# EasyEDA Pro project Archive.eprj, schematic Schematic7_3
Board Name: 11643; Create Date: 2026-04-03; Page Name: P1; Project Name: Jarvis; Schematic Name: Schematic7_3; Update Date: 2026-04-03; Company: EasyEDA.com; Page Size: A4; Version: V1.0
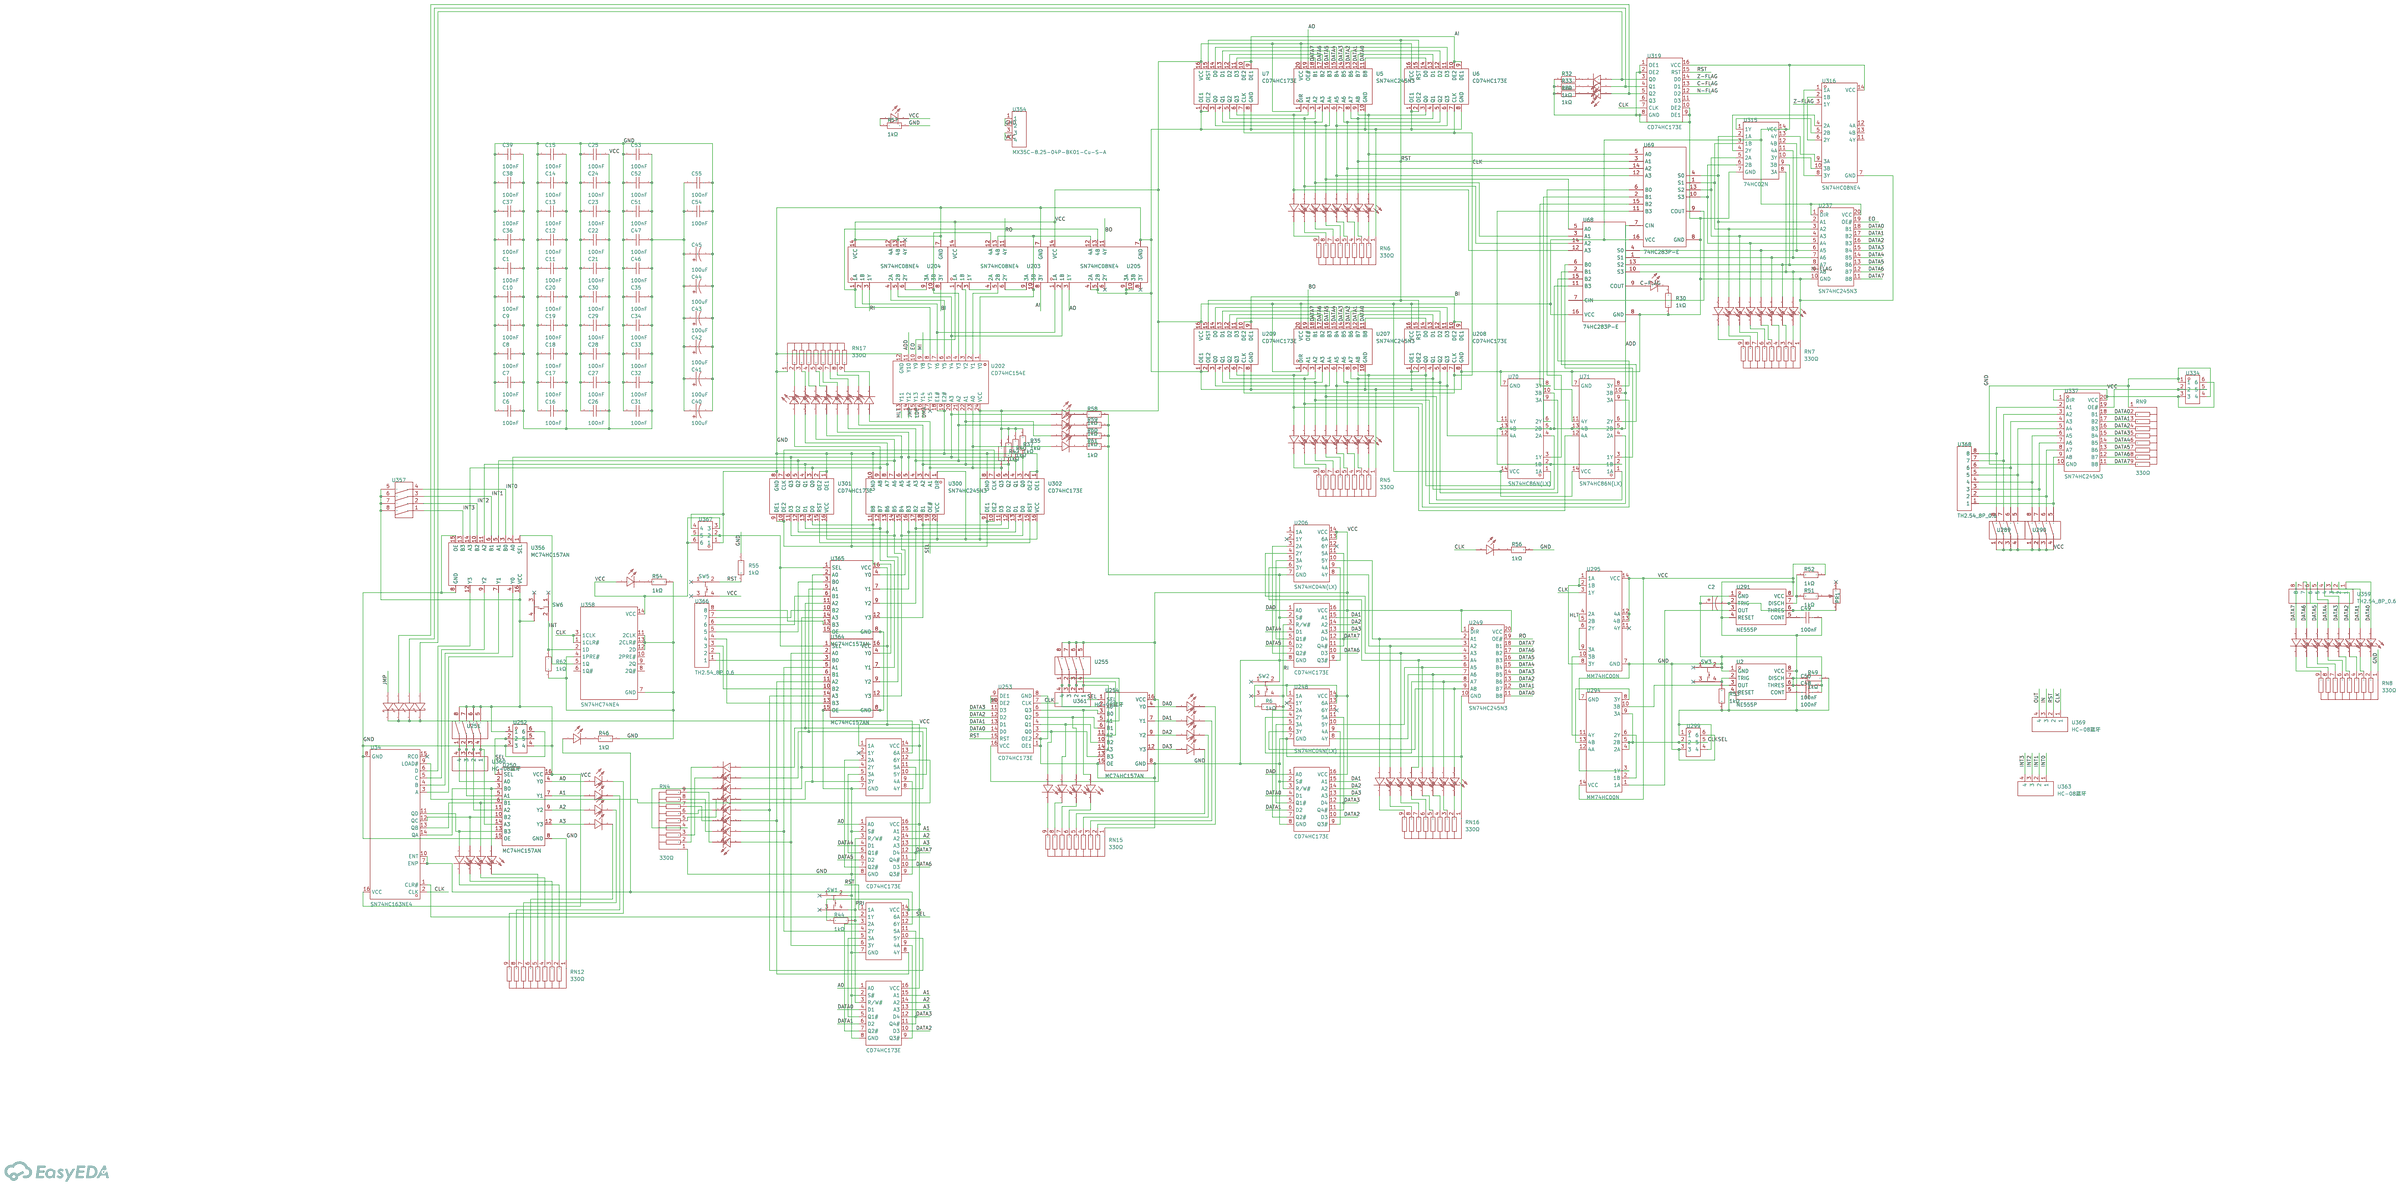
[diagram p0: schematic sheet]

## Parts
C1  100nF  [CAP-TH_L5.0-W2.5-P5.00-D1.0]
C2  100U/16V-6*11  [CAP-TH_BD6.4-P2.50-D0.5-FD]
C6  100nF  [CAP-TH_L5.0-W2.5-P5.00-D1.0]
C7  100nF  [CAP-TH_L5.0-W2.5-P5.00-D1.0]
C8  100nF  [CAP-TH_L5.0-W2.5-P5.00-D1.0]
C9  100nF  [CAP-TH_L5.0-W2.5-P5.00-D1.0]
C10  100nF  [CAP-TH_L5.0-W2.5-P5.00-D1.0]
C11  100nF  [CAP-TH_L5.0-W2.5-P5.00-D1.0]
C12  100nF  [CAP-TH_L5.0-W2.5-P5.00-D1.0]
C13  100nF  [CAP-TH_L5.0-W2.5-P5.00-D1.0]
C14  100nF  [CAP-TH_L5.0-W2.5-P5.00-D1.0]
C15  100nF  [CAP-TH_L5.0-W2.5-P5.00-D1.0]
C16  100nF  [CAP-TH_L5.0-W2.5-P5.00-D1.0]
C17  100nF  [CAP-TH_L5.0-W2.5-P5.00-D1.0]
C18  100nF  [CAP-TH_L5.0-W2.5-P5.00-D1.0]
C19  100nF  [CAP-TH_L5.0-W2.5-P5.00-D1.0]
C20  100nF  [CAP-TH_L5.0-W2.5-P5.00-D1.0]
C21  100nF  [CAP-TH_L5.0-W2.5-P5.00-D1.0]
C22  100nF  [CAP-TH_L5.0-W2.5-P5.00-D1.0]
C23  100nF  [CAP-TH_L5.0-W2.5-P5.00-D1.0]
C24  100nF  [CAP-TH_L5.0-W2.5-P5.00-D1.0]
C25  100nF  [CAP-TH_L5.0-W2.5-P5.00-D1.0]
C26  100nF  [CAP-TH_L5.0-W2.5-P5.00-D1.0]
C27  100nF  [CAP-TH_L5.0-W2.5-P5.00-D1.0]
C28  100nF  [CAP-TH_L5.0-W2.5-P5.00-D1.0]
C29  100nF  [CAP-TH_L5.0-W2.5-P5.00-D1.0]
C30  100nF  [CAP-TH_L5.0-W2.5-P5.00-D1.0]
C31  100nF  [CAP-TH_L5.0-W2.5-P5.00-D1.0]
C32  100nF  [CAP-TH_L5.0-W2.5-P5.00-D1.0]
C33  100nF  [CAP-TH_L5.0-W2.5-P5.00-D1.0]
C34  100nF  [CAP-TH_L5.0-W2.5-P5.00-D1.0]
C35  100nF  [CAP-TH_L5.0-W2.5-P5.00-D1.0]
C36  100nF  [CAP-TH_L5.0-W2.5-P5.00-D1.0]
C37  100nF  [CAP-TH_L5.0-W2.5-P5.00-D1.0]
C38  100nF  [CAP-TH_L5.0-W2.5-P5.00-D1.0]
C39  100nF  [CAP-TH_L5.0-W2.5-P5.00-D1.0]
C40  100uF  [CAP-TH_BD6.3-P2.50-D1.0-FD]
C41  100uF  [CAP-TH_BD6.3-P2.50-D1.0-FD]
C42  100uF  [CAP-TH_BD6.3-P2.50-D1.0-FD]
C43  100uF  [CAP-TH_BD6.3-P2.50-D1.0-FD]
C44  100uF  [CAP-TH_BD6.3-P2.50-D1.0-FD]
C45  100uF  [CAP-TH_BD6.3-P2.50-D1.0-FD]
C46  100nF  [CAP-TH_L5.0-W2.5-P5.00-D1.0]
C47  100nF  [CAP-TH_L5.0-W2.5-P5.00-D1.0]
C48  100nF  [CAP-TH_L5.0-W2.5-P5.00-D1.0]
C49  100nF  [CAP-TH_L5.0-W2.5-P5.00-D1.0]
C50  100nF  [CAP-TH_L5.0-W2.5-P5.00-D1.0]
C51  100nF  [CAP-TH_L5.0-W2.5-P5.00-D1.0]
C52  100nF  [CAP-TH_L5.0-W2.5-P5.00-D1.0]
C53  100nF  [CAP-TH_L5.0-W2.5-P5.00-D1.0]
C54  100nF  [CAP-TH_L5.0-W2.5-P5.00-D1.0]
C55  100nF  [CAP-TH_L5.0-W2.5-P5.00-D1.0]
PR1  -  [RES-ADJ-TH_3362P]
R6  1kΩ  [RES-TH_BD2.3-L6.5-P10.50-D0.5]
R30  1kΩ  [RES-TH_BD2.3-L6.5-P10.50-D0.5]
R32  1kΩ  [RES-TH_BD2.3-L6.5-P10.50-D0.5]
R33  1kΩ  [RES-TH_BD2.3-L6.5-P10.50-D0.5]
R34  1kΩ  [RES-TH_BD2.3-L6.5-P10.50-D0.5]
R35  1kΩ  [RES-TH_BD2.3-L6.5-P10.50-D0.5]
R37  1kΩ  [RES-TH_BD2.3-L6.5-P10.50-D0.5]
R40  1kΩ  [RES-TH_BD2.3-L6.5-P10.50-D0.5]
R42  1kΩ  [RES-TH_BD2.3-L6.5-P10.50-D0.5]
R44  1kΩ  [RES-TH_BD2.3-L6.5-P10.50-D0.5]
R46  1kΩ  [RES-TH_BD2.3-L6.5-P10.50-D0.5]
R49  1kΩ  [RES-TH_BD2.3-L6.5-P10.50-D0.5]
R51  1kΩ  [RES-TH_BD2.3-L6.5-P10.50-D0.5]
R52  1kΩ  [RES-TH_BD2.3-L6.5-P10.50-D0.5]
R53  1kΩ  [RES-TH_BD2.3-L6.5-P10.50-D0.5]
R54  1kΩ  [RES-TH_BD2.3-L6.5-P10.50-D0.5]
R55  1kΩ  [RES-TH_BD2.3-L6.5-P10.50-D0.5]
R56  1kΩ  [RES-TH_BD2.3-L6.5-P10.50-D0.5]
R57  1kΩ  [RES-TH_BD2.3-L6.5-P10.50-D0.5]
R58  1kΩ  [RES-TH_BD2.3-L6.5-P10.50-D0.5]
R59  1kΩ  [RES-TH_BD2.3-L6.5-P10.50-D0.5]
R60  1kΩ  [RES-TH_BD2.3-L6.5-P10.50-D0.5]
R61  1kΩ  [RES-TH_BD2.3-L6.5-P10.50-D0.5]
R62  1kΩ  [RES-TH_BD2.3-L6.5-P10.50-D0.5]
RN4  330Ω  [RES-ARRAY-TH_9P-P2.54-D1.0]
RN5  330Ω  [RES-ARRAY-TH_9P-P2.54-D1.0]
RN6  330Ω  [RES-ARRAY-TH_9P-P2.54-D1.0]
RN7  330Ω  [RES-ARRAY-TH_9P-P2.54-D1.0]
RN8  330Ω  [RES-ARRAY-TH_9P-P2.54-D1.0]
RN9  330Ω  [RES-ARRAY-TH_9P-P2.54-D1.0]
RN12  330Ω  [RES-ARRAY-TH_9P-P2.54-D1.0]
RN15  330Ω  [RES-ARRAY-TH_9P-P2.54-D1.0]
RN16  330Ω  [RES-ARRAY-TH_9P-P2.54-D1.0]
RN17  330Ω  [RES-ARRAY-TH_9P-P2.54-D1.0]
SW1  B3F-1000-S  [KEY-TH_4P-L6.2-W6.2-P4.50-LS6.5]
SW2  B3F-1000-S  [KEY-TH_4P-L6.2-W6.2-P4.50-LS6.5]
SW3  B3F-1000-S  [KEY-TH_4P-L6.2-W6.2-P4.50-LS6.5]
SW5  B3F-1000-S  [KEY-TH_4P-L6.2-W6.2-P4.50-LS6.5]
SW6  B3F-1000-S  [KEY-TH_4P-L6.2-W6.2-P4.50-LS6.5]
U1  CD74HC173E  [PDIP-16_L19.2-W6.6-P2.54-LS7.6-BL]
U2  NE555P  [DIP-8_L9.8-W6.6-P2.54-LS7.6-BL]
U5  SN74HC245N3  [PDIP-20_L25.9-W6.6-P2.54-LS7.9-BL]
U6  CD74HC173E  [PDIP-16_L19.2-W6.6-P2.54-LS7.6-BL]
U7  CD74HC173E  [PDIP-16_L19.2-W6.6-P2.54-LS7.6-BL]
U34  SN74HC163NE4  [PDIP-16_L19.3-W6.4-P2.54-LS7.94-BL]
U68  74HC283P-E  [PDIP-16_L19.3-W6.4-P2.54-LS7.94-BL]
U69  74HC283P-E  [PDIP-16_L19.3-W6.4-P2.54-LS7.94-BL]
U70  SN74HC86N(LX)  [PDIP-14_L19.3-W6.5-P2.54-LS7.6-BL]
U71  SN74HC86N(LX)  [PDIP-14_L19.3-W6.5-P2.54-LS7.6-BL]
U202  CD74HC154E  [DIP-24_L31.0-W13.5-P2.54-LS15.2-BL]
U203  SN74HC08NE4  [PDIP-14_L19.3-W6.5-P2.54-LS7.6-BL]
U204  SN74HC08NE4  [PDIP-14_L19.3-W6.5-P2.54-LS7.6-BL]
U205  SN74HC08NE4  [PDIP-14_L19.3-W6.5-P2.54-LS7.6-BL]
U206  SN74HC04N(LX)  [DIP-14_L19.6-W6.4-P2.54-LS7.6-BL]
U207  SN74HC245N3  [PDIP-20_L25.9-W6.6-P2.54-LS7.9-BL]
U208  CD74HC173E  [PDIP-16_L19.2-W6.6-P2.54-LS7.6-BL]
U209  CD74HC173E  [PDIP-16_L19.2-W6.6-P2.54-LS7.6-BL]
U210  SN74HC04N(LX)  [DIP-14_L19.6-W6.4-P2.54-LS7.6-BL]
U211  CD74HC173E  [PDIP-16_L19.2-W6.6-P2.54-LS7.6-BL]
U212  SN74HC04N(LX)  [DIP-14_L19.6-W6.4-P2.54-LS7.6-BL]
U213  LED  [LED-TH_BD4.0-P2.54-FD_RED]
U214  LED  [LED-TH_BD4.0-P2.54-FD_RED]
U215  LED  [LED-TH_BD4.0-P2.54-FD_RED]
U216  LED  [LED-TH_BD4.0-P2.54-FD_RED]
U217  LED  [LED-TH_BD4.0-P2.54-FD_RED]
U218  LED  [LED-TH_BD4.0-P2.54-FD_RED]
U219  LED  [LED-TH_BD4.0-P2.54-FD_RED]
U220  LED  [LED-TH_BD4.0-P2.54-FD_RED]
U221  LED  [LED-TH_BD4.0-P2.54-FD_RED]
U222  LED  [LED-TH_BD4.0-P2.54-FD_RED]
U223  LED  [LED-TH_BD4.0-P2.54-FD_RED]
U224  LED  [LED-TH_BD4.0-P2.54-FD_RED]
U225  LED  [LED-TH_BD4.0-P2.54-FD_RED]
U226  LED  [LED-TH_BD4.0-P2.54-FD_RED]
U227  LED  [LED-TH_BD4.0-P2.54-FD_RED]
U228  LED  [LED-TH_BD4.0-P2.54-FD_RED]
U229  LED  [LED-TH_BD4.0-P2.54-FD_RED]
U230  LED  [LED-TH_BD4.0-P2.54-FD_RED]
U231  LED  [LED-TH_BD4.0-P2.54-FD_RED]
U232  LED  [LED-TH_BD4.0-P2.54-FD_RED]
U233  LED  [LED-TH_BD4.0-P2.54-FD_RED]
U234  LED  [LED-TH_BD4.0-P2.54-FD_RED]
U235  LED  [LED-TH_BD4.0-P2.54-FD_RED]
U236  LED  [LED-TH_BD4.0-P2.54-FD_RED]
U237  SN74HC245N3  [PDIP-20_L25.9-W6.6-P2.54-LS7.9-BL]
U238  LED  [LED-TH_BD4.0-P2.54-FD_RED]
U239  LED  [LED-TH_BD4.0-P2.54-FD_RED]
U240  LED  [LED-TH_BD4.0-P2.54-FD_RED]
U241  LED  [LED-TH_BD4.0-P2.54-FD_RED]
U242  LED  [LED-TH_BD4.0-P2.54-FD_RED]
U243  LED  [LED-TH_BD4.0-P2.54-FD_RED]
U244  LED  [LED-TH_BD4.0-P2.54-FD_RED]
U245  LED  [LED-TH_BD4.0-P2.54-FD_RED]
U248  SN74HC04N(LX)  [DIP-14_L19.6-W6.4-P2.54-LS7.6-BL]
U249  SN74HC245N3  [PDIP-20_L25.9-W6.6-P2.54-LS7.9-BL]
U250  MC74HC157AN  [PDIP-16_L19.3-W6.4-P2.54-LS7.94-BL]
U251  switch4bitDIP  [DIP-8_L11.2-W6.2-P2.54-LS7.6-BL]
U252  KEY_8*8  [KEY-TH_6P-L7.1-W7.1-P2.00]
U253  CD74HC173E  [PDIP-16_L19.2-W6.6-P2.54-LS7.6-BL]
U254  MC74HC157AN  [PDIP-16_L19.3-W6.4-P2.54-LS7.94-BL]
U255  switch4bitDIP  [DIP-8_L11.2-W6.2-P2.54-LS7.6-BL]
U256  LED  [LED-TH_BD4.0-P2.54-FD_RED]
U257  LED  [LED-TH_BD4.0-P2.54-FD_RED]
U258  LED  [LED-TH_BD4.0-P2.54-FD_RED]
U259  LED  [LED-TH_BD4.0-P2.54-FD_RED]
U268  LED  [LED-TH_BD4.0-P2.54-FD_RED]
U269  LED  [LED-TH_BD4.0-P2.54-FD_RED]
U270  LED  [LED-TH_BD4.0-P2.54-FD_RED]
U271  LED  [LED-TH_BD4.0-P2.54-FD_RED]
U272  LED  [LED-TH_BD4.0-P2.54-FD_RED]
U273  LED  [LED-TH_BD4.0-P2.54-FD_RED]
U274  LED  [LED-TH_BD4.0-P2.54-FD_RED]
U275  LED  [LED-TH_BD4.0-P2.54-FD_RED]
U276  LED  [LED-TH_BD4.0-P2.54-FD_RED]
U277  LED  [LED-TH_BD4.0-P2.54-FD_RED]
U278  LED  [LED-TH_BD4.0-P2.54-FD_RED]
U279  LED  [LED-TH_BD4.0-P2.54-FD_RED]
U280  LED  [LED-TH_BD4.0-P2.54-FD_RED]
U281  LED  [LED-TH_BD4.0-P2.54-FD_RED]
U282  LED  [LED-TH_BD4.0-P2.54-FD_RED]
U283  LED  [LED-TH_BD4.0-P2.54-FD_RED]
U284  LED  [LED-TH_BD4.0-P2.54-FD_RED]
U285  LED  [LED-TH_BD4.0-P2.54-FD_RED]
U286  LED  [LED-TH_BD4.0-P2.54-FD_RED]
U287  LED  [LED-TH_BD4.0-P2.54-FD_RED]
U288  LED  [LED-TH_BD4.0-P2.54-FD_RED]
U289  switch4bitDIP  [DIP-8_L11.2-W6.2-P2.54-LS7.6-BL]
U290  switch4bitDIP  [DIP-8_L11.2-W6.2-P2.54-LS7.6-BL]
U291  NE555P  [DIP-8_L9.8-W6.6-P2.54-LS7.6-BL]
U294  MM74HC00N  [PDIP-14_L19.3-W6.4-P2.54-LS9.0-BL]
U295  MM74HC00N  [PDIP-14_L19.3-W6.4-P2.54-LS9.0-BL]
U296  CD74HC173E  [PDIP-16_L19.2-W6.6-P2.54-LS7.6-BL]
U297  CD74HC173E  [PDIP-16_L19.2-W6.6-P2.54-LS7.6-BL]
U298  LED  [LED-TH_BD4.0-P2.54-FD_RED]
U299  KEY_8*8  [KEY-TH_6P-L7.1-W7.1-P2.00]
U300  SN74HC245N3  [PDIP-20_L25.9-W6.6-P2.54-LS7.9-BL]
U301  CD74HC173E  [PDIP-16_L19.2-W6.6-P2.54-LS7.6-BL]
U302  CD74HC173E  [PDIP-16_L19.2-W6.6-P2.54-LS7.6-BL]
U307  LED  [LED-TH_BD4.0-P2.54-FD_RED]
U308  LED  [LED-TH_BD4.0-P2.54-FD_RED]
U309  LED  [LED-TH_BD4.0-P2.54-FD_RED]
U310  LED  [LED-TH_BD4.0-P2.54-FD_RED]
U311  LED  [LED-TH_BD4.0-P2.54-FD_RED]
U312  LED  [LED-TH_BD4.0-P2.54-FD_RED]
U313  LED  [LED-TH_BD4.0-P2.54-FD_RED]
U314  LED  [LED-TH_BD4.0-P2.54-FD_RED]
U315  74HC02N  [DIP-14_L19.6-W6.4-P2.54-LS7.6-BL]
U316  SN74HC08NE4  [PDIP-14_L19.3-W6.5-P2.54-LS7.6-BL]
U319  CD74HC173E  [PDIP-16_L19.2-W6.6-P2.54-LS7.6-BL]
U322  LED  [LED-TH_BD4.0-P2.54-FD_RED]
U328  LED  [LED-TH_BD4.0-P2.54-FD_RED]
U329  LED  [LED-TH_BD4.0-P2.54-FD_RED]
U330  LED  [LED-TH_BD4.0-P2.54-FD_RED]
U331  LED  [LED-TH_BD4.0-P2.54-FD_RED]
U332  LED  [LED-TH_BD4.0-P2.54-FD_RED]
U334  KEY_8*8  [KEY-TH_6P-L7.1-W7.1-P2.00]
U337  SN74HC245N3  [PDIP-20_L25.9-W6.6-P2.54-LS7.9-BL]
U338  LED  [LED-TH_BD4.0-P2.54-FD_RED]
U339  LED  [LED-TH_BD4.0-P2.54-FD_RED]
U340  LED  [LED-TH_BD4.0-P2.54-FD_RED]
U341  LED  [LED-TH_BD4.0-P2.54-FD_RED]
U342  LED  [LED-TH_BD4.0-P2.54-FD_RED]
U343  LED  [LED-TH_BD4.0-P2.54-FD_RED]
U344  LED  [LED-TH_BD4.0-P2.54-FD_RED]
U345  LED  [LED-TH_BD4.0-P2.54-FD_RED]
U346  LED  [LED-TH_BD4.0-P2.54-FD_RED]
U347  LED  [LED-TH_BD4.0-P2.54-FD_RED]
U348  LED  [LED-TH_BD4.0-P2.54-FD_RED]
U349  LED  [LED-TH_BD4.0-P2.54-FD_RED]
U350  1N4007-DIODE  [DO-41_BD2.4-L4.7-P8.70-D0.8-FD]
U351  1N4007-DIODE  [DO-41_BD2.4-L4.7-P8.70-D0.8-FD]
U352  1N4007-DIODE  [DO-41_BD2.4-L4.7-P8.70-D0.8-FD]
U353  1N4007-DIODE  [DO-41_BD2.4-L4.7-P8.70-D0.8-FD]
U354  MX35C-8.25-04P-BK01-Cu-S-A  [CONN-TH_4P-P8.25_MX35C-8.25-04P-BK01-CU-S-A]
U356  MC74HC157AN  [PDIP-16_L19.3-W6.4-P2.54-LS7.94-BL]
U357  switch4bitDIP  [DIP-8_L11.2-W6.2-P2.54-LS7.6-BL]
U358  SN74HC74NE4  [PDIP-14_L19.3-W6.4-P2.54-LS9.0-BL]
U359  TH2.54_8P_0.6  [HDR-TH_8P-P2.54-V-M-3]
U360  HC-08蓝牙  [HDR-TH_4P-P2.54-V-F]
U361  HC-08蓝牙  [HDR-TH_4P-P2.54-V-F]
U363  HC-08蓝牙  [HDR-TH_4P-P2.54-V-F]
U364  MC74HC157AN  [PDIP-16_L19.3-W6.4-P2.54-LS7.94-BL]
U365  MC74HC157AN  [PDIP-16_L19.3-W6.4-P2.54-LS7.94-BL]
U366  TH2.54_8P_0.6  [HDR-TH_8P-P2.54-V-M-3]
U367  KEY_8*8  [KEY-TH_6P-L7.1-W7.1-P2.00]
U368  TH2.54_8P_0.6  [HDR-TH_8P-P2.54-V-M-3]
U369  HC-08蓝牙  [HDR-TH_4P-P2.54-V-F]

## Library data of the parts
C1 C6-C39 C46-C55 = 178MU0006: Capacitance:100nF Tolerance:±10% Tolerance:±10% Voltage Rating:50V Temperature Coefficient:X7R Pin Spacing:2.54mm; LCSC Part Name: 100nF ±10% 50V; Supplier Part: C5632430; Manufacturer: KNSCHA(科尼盛); Supplier Footprint: 插件,P=2.54mm; JLCPCB Part Class: Extended Part; Datasheet: https://item.szlcsc.com/datasheet/178MU0006/6552585.html; Supplier: LCSC; Tolerance: ±10%; Voltage Rating: 50V; Temperature Coefficient: X7R; Pin Spacing: 2.54mm
C2 = 100U/16V-6*11: Supplier Part: C9900003239; Supplier Footprint: CAP-TH-BD6.4-P2.26-D0.5; JLCPCB Part Class: Extended Part; Supplier: LCSC
C40-C45 = NXA35VB100M6.3*11_LO: Capacitance: Rated Voltage: Lead Spacing: φD: L: Lifetime @ Temp:; LCSC Part Name: 100uF 35V; Supplier Part: C346956; Supplier Footprint: 插件,6.3x11mm; JLCPCB Part Class: Extended Part; Supplier: LCSC
PR1 = 环保 3362P-1-503LF: Resistance:- Rated Voltage:- Power(Watts):- Turns:-; LCSC Part Name: 50KΩ; Supplier Part: C5054; Supplier Footprint: VR-3362P; JLCPCB Part Class: Extended Part; Supplier: LCSC
R6 R30 R32-R35 R37 R40 R42 R44 R46 R49 R51-R62 = MF1/4W-1KΩ±1%T52: Type:Metal Film Resistors Resistance: Tolerance:±1% Tolerance:±1% Power(Watts):250mW Temperature Coefficient:±200ppm/℃ Temperature Coefficient:±200ppm/℃; LCSC Part Name: 金属膜电阻 1kΩ ±1% 250mW; Supplier Part: C713997; Manufacturer: 华星机电; Supplier Footprint: 插件,D2.3xL6.5mm; JLCPCB Part Class: Extended Part; Datasheet: https://atta.szlcsc.com/upload/public/pdf/source/20200731/C713882_AE8EB1102749D7E4FB4FB13DC898C429.pdf; Supplier: LCSC; Type: Metal Film Resistors; Tolerance: ±1%; Power(Watts): 250mW; Temperature Coefficient: ±200ppm/℃
RN4-RN9 RN12 RN15-RN17 = RAA09331G: Number of Resistors: Resistance: Tolerance:±2% Tolerance:±2% Power(Watts): Temperature Coefficient:±100ppm/℃ Temperature Coefficient:±100ppm/℃ Number of Pins:; LCSC Part Name: 330Ω ±2%; Supplier Part: C353617; Manufacturer: Monec(鑫汇); Supplier Footprint: SIP-9-2.54mm; JLCPCB Part Class: Extended Part; Datasheet: https://atta.szlcsc.com/upload/public/pdf/source/20190415/C353617_CE0FBC2F670EA1E78594FBF4B85EE317.pdf; Supplier: LCSC; Tolerance: ±2%; Temperature Coefficient: ±100ppm/℃
SW1-SW3 SW5 SW6 = B3F-1000-S: Supplier Part: C19724130; Manufacturer: OMRON(欧姆龙); Supplier Footprint: SW-TH_4P; JLCPCB Part Class: Extended Part; Datasheet: https://item.szlcsc.com/datasheet/B3F-1000-S/21045793.html; Supplier: LCSC
U1 U6 U7 U208 U209 U211 U253 U296 U297 U301 U302 U319 = CD74HC173E: Type:D-Type Trigger Type:Rising Edge Voltage - Supply:2V~6V Voltage - Supply:2V~6V Clock Frequency:60MHz Function:Reset Number of Elements:1 Number of Bits per Element:4 Output Type:Tri-State Propagation Delay:34ns@6V,50pF Series:74HC Series Current - Out; LCSC Part Name: 三态高速CMOS逻辑四路D型触发器; Supplier Part: C1549968; Manufacturer: TI(德州仪器); Supplier Footprint: PDIP-16; JLCPCB Part Class: Extended Part; Datasheet: https://www.ti.com/cn/lit/gpn/cd74hct173; Supplier: LCSC; Type: D-Type; Trigger Type: Rising Edge; Voltage - Supply: 2V~6V; Clock Frequency: 60MHz; Function: Reset; Number of Elements: 1; Number of Bits per Element: 4; Output Type: Tri-State; Propagation Delay: 34ns@6V,50pF; Series: 74HC Series; Current - Output Low(IOL): 7.8mA; Current - Output High(IOH): 7.8mA; Quiescent Current: 8uA; Input Capacitance: 10pF; Operating Temperature: -55℃~+125℃; Setup Time: 12ns; Hold Time: 3ns
U2 U291 = NE555P: Supplier Part: C46749; Manufacturer: TI(德州仪器); Supplier Footprint: DIP-8; JLCPCB Part Class: Extended Part; Datasheet: https://www.ti.com/cn/lit/gpn/ne555; Supplier: LCSC
U5 U207 U237 U249 U300 U337 = SN74HC245N3: Input type:- output type:Tri-State Voltage - Supply:2V~6V Voltage - Supply:2V~6V Number of Elements:1 Number of Bits per Element:8 Channel Type:Bidirectional Current - Output Low(IOL):7.8mA Current - Output High(IOH):7.8mA Logic Family:74HC Operating Temp; Supplier Part: C3587488; Manufacturer: TI(德州仪器); Supplier Footprint: PDIP-20; JLCPCB Part Class: Extended Part; Datasheet: https://item.szlcsc.com/datasheet/SN74HC245N3/4154202.html; Supplier: LCSC; output type: Tri-State; Voltage - Supply: 2V~6V; Number of Elements: 1; Number of Bits per Element: 8; Channel Type: Bidirectional; Current - Output Low(IOL): 7.8mA; Current - Output High(IOH): 7.8mA; Logic Family: 74HC; Operating Temperature: -40℃~+85℃; Quiescent Current: 80uA; Propagation Delay: 21ns@4.5V,50pF
U34 = SN74HC163NE4: Supplier Part: C20345717; Manufacturer: TI(德州仪器); Supplier Footprint: PDIP-16; JLCPCB Part Class: Extended Part; Datasheet: https://atta.szlcsc.com/upload/public/pdf/source/20240116/FC6F7C80FC5EB51F2BFA3EE0E58B1708.pdf; Supplier: LCSC
U68 U69 = 74HC283P-E: Supplier Part: C17688236; Manufacturer: RENESAS(瑞萨)/IDT; Datasheet: https://item.szlcsc.com/datasheet/74HC283P-E/18817510.html; Supplier: LCSC
U70 U71 = SN74HC86N(LX): Logic Type:XOR Gate Number of Channels:4 Voltage - Supply:2V~6V Voltage - Supply:2V~6V Quiescent Current:2uA Input Logic Level - High:1.5V~4.2V Input Logic Level - High:1.5V~4.2V Input Logic Level - Low:500mV~1.8V Input Logic Level - Low:500mV~1.8V Series; LCSC Part Name: 集成电路; Supplier Part: C22436661; Manufacturer: LX(灵星芯微); Supplier Footprint: DIP-14; JLCPCB Part Class: Extended Part; Datasheet: https://atta.szlcsc.com/upload/public/pdf/source/20240524/675B1C928075FFB7AC00BEC82378813F.pdf; Supplier: LCSC; Logic Type: XOR Gate; Number of Channels: 4; Voltage - Supply: 2V~6V; Quiescent Current: 2uA; Input Logic Level - High: 1.5V~4.2V; Input Logic Level - Low: 500mV~1.8V; Series: 74HCSeries; Operating Temperature: -40℃~+125℃
U202 = CD74HC154E: Supplier Part: C5342; Supplier Footprint: DIP-24-600mil; JLCPCB Part Class: Extended Part; Supplier: LCSC
U203-U205 U316 = SN74HC08NE4: Logic Type:AND Gate Number of Channels:4 Voltage - Supply:2V~6V Voltage - Supply:2V~6V Quiescent Current:20uA Current - Output Low(IOL):5.2mA Current - Output High(IOH):5.2mA Input Logic Level - High:1.5V；4.2V；3.15V Input Logic Level - High:1.5V；4.2V；3.15; Supplier Part: C20345708; Manufacturer: TI(德州仪器); Supplier Footprint: PDIP-14; JLCPCB Part Class: Extended Part; Datasheet: https://item.szlcsc.com/datasheet/SN74HC08NE4/21671235.html; Supplier: LCSC; Logic Type: AND Gate; Number of Channels: 4; Voltage - Supply: 2V~6V; Quiescent Current: 20uA; Current - Output Low(IOL): 5.2mA; Current - Output High(IOH): 5.2mA; Input Logic Level - High: 1.5V；4.2V；3.15V; Input Logic Level - Low: 1.35V；500mV；1.8V; Output Logic Level - High: 4.4V；5.9V；1.9V; Output Logic Level - Low: 330mV；260mV；100mV; Series: 74HC; Propagation Delay: 25ns@4.5V,50pF; Operating Temperature: -40℃~+85℃; Input Number: 2
U206 U210 U212 U248 = SN74HC04N(LX): Input Type:- Voltage - Supply:2V~6V Voltage - Supply:2V~6V Quiescent Current(Iq):2uA Number of Circuits:6 Number of Inputs:- Current - Output Low(IOL):- Current - Output High(IOH):- Input Logic Level - High:1.5V~4.2V Input Logic Level - High:1.5V~4.2V Inp; LCSC Part Name: 集成电路; Supplier Part: C22436641; Manufacturer: LX(灵星芯微); Supplier Footprint: DIP-14; JLCPCB Part Class: Extended Part; Datasheet: https://item.szlcsc.com/datasheet/SN74HC04N(LX)/24070577.html; Supplier: LCSC; Voltage - Supply: 2V~6V; Quiescent Current(Iq): 2uA; Number of Circuits: 6; Input Logic Level - High: 1.5V~4.2V; Input Logic Level -Low: 500mV~1.8V; Output Logic Level - High: 4.4V；5.9V；1.9V; Output Logic Level - Low: 260mV；260mV；100mV; Propagation Delay: 14ns@6V,50pF; Series: 74HC Series; Operating Temperature: -40℃~+125℃
U213-U236 U238-U245 U256-U259 U268-U288 U298 U307-U314 U322 U328-U332 U338-U349 = LED: Supplier Part: C9900015665; Supplier Footprint: SIP-2P; JLCPCB Part Class: Extended Part; Supplier: LCSC
U250 U254 U356 U364 U365 = MC74HC157AN: Type:Data Selector/Multiplexers Voltage Supply Source:Single supply Supply Voltage:2V~6V Supply Voltage:2V~6V Sink Current:7.8mA Source Current:7.8mA Operating temperature:-55℃~+125℃ Operating temperature:-55℃~+125℃; Supplier Part: C3231585; Manufacturer: onsemi(安森美); Supplier Footprint: PDIP-16; Datasheet: https://atta.szlcsc.com/upload/public/pdf/source/20230915/AA5F4BE3BD1C30F26D22E0E41BE72F14.pdf; Supplier: LCSC; Type: Data Selector/Multiplexers; Voltage Supply Source: Single supply; Supply Voltage: 2V~6V; Sink Current: 7.8mA; Source Current: 7.8mA; Operating temperature: -55℃~+125℃
U251 U255 U289 U290 U357 = switch4bitDIP: Supplier Part: C9900002361; Supplier Footprint: DIP-8_L11.16-W6.2-P2.54-LS7.62; Supplier: LCSC
U252 U299 U334 U367 = KEY_8*8: Supplier Part: C9900001793; Supplier Footprint: SW-TH_6P-L7.1-W7.1-P2.00-LS4.9; JLCPCB Part Class: Extended Part; Supplier: LCSC
U294 U295 = MM74HC00N: Logic Type:NAND Gate Number of Channels:4 Voltage - Supply:2V~6V Voltage - Supply:2V~6V Quiescent Current:2uA Current - Output Low(IOL):5.2mA Current - Output High(IOH):5.2mA Input Logic Level - High:1.5V~4.2V Input Logic Level - High:1.5V~4.2V Input Logi; Supplier Part: C4472810; Manufacturer: TI(德州仪器); Supplier Footprint: DIP-14; JLCPCB Part Class: Extended Part; Datasheet: https://atta.szlcsc.com/upload/public/pdf/source/20230920/AE4EE648A4D81869CF07AF2DDCC9D708.pdf; Supplier: LCSC; Logic Type: NAND Gate; Number of Channels: 4; Voltage - Supply: 2V~6V; Quiescent Current: 2uA; Current - Output Low(IOL): 5.2mA; Current - Output High(IOH): 5.2mA; Input Logic Level - High: 1.5V~4.2V; Series: 74HC Series; Propagation Delay: 15ns@6V,50pF; Operating Temperature: -40℃~+85℃
U315 = 74HC02N: Logic Type:NOR Gate Number of Channels:4 Voltage - Supply:2V~6V Voltage - Supply:2V~6V Quiescent Current:40uA Current - Output Low(IOL):25mA Current - Output High(IOH):25mA Input Logic Level - High:2.1V~4.2V Input Logic Level - High:2.1V~4.2V Input Logic; LCSC Part Name: 四路 2 输入 或非门; Supplier Part: C507193; Manufacturer: HGSEMI(华冠); Supplier Footprint: DIP-14; JLCPCB Part Class: Extended Part; Datasheet: https://item.szlcsc.com/datasheet/74HC02N/520631.html; Supplier: LCSC; Logic Type: NOR Gate; Number of Channels: 4; Voltage - Supply: 2V~6V; Quiescent Current: 40uA; Current - Output Low(IOL): 25mA; Current - Output High(IOH): 25mA; Input Logic Level - High: 2.1V~4.2V; Input Logic Level - Low: 900mV~1.8V; Output Logic Level - High: 4.4V~5.9V; Output Logic Level - Low: 100mV; Series: 74HC Series; Propagation Delay: 13ns@4.5V,50pF; Operating Temperature: -40℃~+85℃; Input Number: 2
U350-U353 = 1N4007-DIODE: Supplier Part: C9900005663; Supplier Footprint: DO-41; JLCPCB Part Class: Extended Part; Supplier: LCSC
U354 = MX35C-8.25-04P-BK01-Cu-S-A: Barrier Type:2-Side Pitch:8.25mm Number of Positions or Pins:1x4P Mounting Type:Straight Pin Location:Mid Terminal Number of Pins:4P Number of Rows:1 Number of PINs Per Row:4 Screw Specification:M3 Current Rating:20A Voltage Rating (Max):300V Wire Gauge -; LCSC Part Name: 8.25mm 1x4P 直插 中脚 排数:1 每排P数:4; Supplier Part: C5290387; Manufacturer: MAX(迈旭); Supplier Footprint: 插件,P=8.25mm; JLCPCB Part Class: Extended Part; Datasheet: https://item.szlcsc.com/datasheet/MX35C-8.25-04P-BK01-Cu-S-A/6031590.html; Supplier: LCSC; Barrier Type: 2-Side; Pitch: 8.25mm; Number of Positions or Pins: 1x4P; Mounting Type: Straight; Pin Location: Mid Terminal; Number of Pins: 4P; Number of Rows: 1; Number of PINs Per Row: 4; Screw Specification: M3; Current Rating: 20A; Voltage Rating (Max): 300V; Wire Gauge - AWG: 12~22; Wire Gauge - mm2: 2.5; Operating Temperature: -40℃~+105℃; Color: Black
U358 = SN74HC74NE4: Type:D-Type Trigger Type:Rising Edge Voltage - Supply:2V~6V Voltage - Supply:2V~6V Clock Frequency:31MHz Function:Set and Reset Number of Elements:2 Number of Bits per Element:1 Output Type:Push-Pull Propagation Delay:35ns Series:74HC Series Current - Out; LCSC Part Name: 双D型正边沿触发触发器，带清零和预置功能; Supplier Part: C20345733; Manufacturer: TI(德州仪器); Supplier Footprint: PDIP-14; JLCPCB Part Class: Extended Part; Datasheet: https://item.szlcsc.com/datasheet/SN74HC74NE4/21671260.html; Supplier: LCSC; Type: D-Type; Trigger Type: Rising Edge; Voltage - Supply: 2V~6V; Clock Frequency: 31MHz; Function: Set and Reset; Number of Elements: 2; Number of Bits per Element: 1; Output Type: Push-Pull; Propagation Delay: 35ns; Series: 74HC Series; Current - Output Low(IOL): 4mA; Current - Output High(IOH): 4mA; Quiescent Current: 4uA; Input Capacitance: 3pF; Operating Temperature: -40℃~+85℃; Synchronous/Asynchronous: Asynchronous; Setup Time: 20ns; Hold Time: 0ns
U359 U366 U368 = TH2.54_8P_0.6: Supplier Part: C9900018349; Supplier Footprint: HDR-TH-8P; JLCPCB Part Class: Extended Part; Supplier: LCSC
U360 U361 U363 U369 = HC-08蓝牙: Supplier Part: C9900016778; Supplier Footprint: HDR-TH_4P; JLCPCB Part Class: Extended Part; Supplier: LCSC

## Nets
GND: C1.2 C2.1 C6.2 C7.2 C8.2 C9.2 C10.2 C11.2 C12.2 C13.2 C14.2 C15.2 C16.2 C17.2 C18.2 C19.2 C20.2 C21.2 C22.2 C23.2 C24.2 C25.2 C26.2 C27.2 C28.2 C29.2 C30.2 C31.2 C32.2 C33.2 C34.2 C35.2 C36.2 C37.2 C38.2 C39.2 C40.2 C41.2 C42.2 C43.2 C44.2 C45.2 C46.2 C47.2 C48.1 C50.1 C51.2 C52.2 C53.2 C54.1 C55.1 R30.1 R32.2 R33.2 R34.2 R46.1 R54.1 R55.1 R56.2 R57.2 R58.2 R59.2 R60.2 R61.2 R62.2 RN4.1 RN5.1 RN6.1 RN7.1 RN8.1 RN9.1 RN12.1 RN15.1 RN16.1 RN17.1 SW1.2 SW2.2 SW3.2 U1.2(S#) U1.8(GND) U2.1(GND) U5.10(GND) U6.1(OE1) U6.2(OE2) U6.8(GND) U7.1(OE1) U7.2(OE2) U7.8(GND) U34.8(GND) U68.8(GND) U69.8(GND) U70.7(GND) U71.7(GND) U202.12(GND) U202.18(E1#) U202.19(E2#) U203.7(GND) U204.7(GND) U204.12(4A) U204.13(4B) U205.4(2A) U205.5(2B) U205.7(GND) U205.9(3A) U205.10(3B) U206.7(GND) U207.10(GND) U208.1(OE1) U208.2(OE2) U208.8(GND) U209.1(OE1) U209.2(OE2) U209.8(GND) U210.7(GND) U211.2(S#) U211.8(GND) U212.7(GND) U237.10(GND) U248.7(GND) U249.10(GND) U250.8(GND) U250.15(OE) U252.3 U252.6 U253.1(OE1) U253.2(OE2) U253.8(GND) U254.8(GND) U254.15(OE) U291.1(GND) U294.7(GND) U295.7(GND) U296.2(S#) U296.8(GND) U297.2(S#) U297.8(GND) U299.3 U299.6 U300.10(GND) U301.1(OE1) U301.2(OE2) U301.8(GND) U301.9(DE1) U301.10(DE2) U302.1(OE1) U302.2(OE2) U302.8(GND) U302.9(DE1) U302.10(DE2) U315.7(GND) U316.7(GND) U319.1(OE1) U319.2(OE2) U319.8(GND) U319.9(DE1) U319.10(DE2) U334.1 U334.4 U337.10(GND) U354.1 U354.2 U356.8(GND) U356.15(OE) U358.4(1PRE#) U358.7(GND) U358.11(2CLK) U358.12(2D) U358.13(2CLR#) U364.8(GND) U364.15(OE) U365.8(GND) U365.15(OE) U367.1 U367.4
VCC: C1.1 C6.1 C7.1 C8.1 C9.1 C10.1 C11.1 C12.1 C13.1 C14.1 C15.1 C16.1 C17.1 C18.1 C19.1 C20.1 C21.1 C22.1 C23.1 C24.1 C25.1 C26.1 C27.1 C28.1 C29.1 C30.1 C31.1 C32.1 C33.1 C34.1 C35.1 C36.1 C37.1 C38.1 C39.1 C40.1 C41.1 C42.1 C43.1 C44.1 C45.1 C46.1 C47.1 C49.1 C51.1 C52.1 C53.1 C54.2 C55.2 R6.1 R35.1 R37.1 R40.1 R42.1 R44.2 R49.1 R52.1 R53.2 SW5.4 SW6.4 U1.16(VCC) U2.4(RESET) U2.8(VCC) U5.1(DIR) U5.20(VCC) U6.16(VCC) U7.16(VCC) U34.16(VCC) U68.16(VCC) U69.16(VCC) U70.14(VCC) U71.14(VCC) U202.24(VCC) U203.14(VCC) U204.14(VCC) U205.14(VCC) U206.13(6A) U206.14(VCC) U207.1(DIR) U207.20(VCC) U208.16(VCC) U209.16(VCC) U210.1(1A) U210.14(VCC) U211.16(VCC) U212.14(VCC) U237.1(DIR) U237.20(VCC) U248.1(1A) U248.13(6A) U248.14(VCC) U249.1(DIR) U249.20(VCC) U250.16(VCC) U251.5 U251.6 U251.7 U251.8 U252.1 U252.4 U253.16(VCC) U254.16(VCC) U255.5 U255.6 U255.7 U255.8 U289.1 U289.2 U289.3 U289.4 U290.1 U290.2 U290.3 U290.4 U291.4(RESET) U291.8(VCC) U294.14(VCC) U295.12(4A) U295.13(4B) U295.14(VCC) U296.16(VCC) U297.16(VCC) U299.1 U299.4 U300.1(DIR) U300.20(VCC) U301.16(VCC) U302.16(VCC) U315.14(VCC) U316.14(VCC) U319.16(VCC) U330.1(+) U332.2(-) U334.3 U334.6 U337.1(DIR) U337.20(VCC) U354.3 U354.4 U356.16(VCC) U357.5 U357.6 U357.7 U357.8 U358.14(VCC) U364.16(VCC) U365.16(VCC) U367.3 U367.6
A0: U1.1(A0) U211.1(A0) U250.4(Y0) U271.1(+)
A1: U1.15(A1) U211.15(A1) U250.7(Y1) U268.1(+)
A2: U1.14(A2) U211.14(A2) U250.9(Y2) U269.1(+)
A3: U1.13(A3) U211.13(A3) U250.12(Y3) U270.1(+)
ADD: U69.7(CIN) U70.2(1B) U70.5(2B) U70.10(3B) U70.13(4B) U71.2(1B) U71.5(2B) U71.10(3B) U71.13(4B) U202.11(Y10)
AI: U6.9(DE1) U6.10(DE2) U7.9(DE1) U7.10(DE2) U203.8(3Y)
AO: U5.19(OE#) U205.3(1Y)
BI: U204.8(3Y) U208.9(DE1) U208.10(DE2) U209.9(DE1) U209.10(DE2)
BO: U205.11(4Y) U207.19(OE#)
C-FLAG: U68.9(COUT) U298.1(+) U319.13(D1)
CLK: U6.7(CLK) U7.7(CLK) U34.2(CLK) U208.7(CLK) U209.7(CLK) U253.7(CLK) U295.3(1Y) U319.7(CLK) U331.1(+) U358.1(1CLR#) U358.3(1CLK) U369.1
CLKSEL: U294.4(2A) U294.5(2B) U294.9(3A) U299.2 U299.5
DA0: U254.4(Y0) U275.1(+) U296.1(A0) U297.1(A0)
DA1: U254.7(Y1) U272.1(+) U296.15(A1) U297.15(A1)
DA2: U254.9(Y2) U273.1(+) U296.14(A2) U297.14(A2)
DA3: U254.12(Y3) U274.1(+) U296.13(A3) U297.13(A3)
DATA0: RN9.2 U5.11(B8) U6.14(D0) U207.11(B8) U208.14(D0) U211.4(D1) U237.18(B1) U249.11(B8) U253.14(D0) U288.1(+) U297.4(D1) U337.18(B1) U359.1
DATA1: RN9.3 U5.12(B7) U6.13(D1) U207.12(B7) U208.13(D1) U211.6(D2) U237.17(B2) U249.12(B7) U253.13(D1) U281.1(+) U297.6(D2) U337.17(B2) U359.2
DATA2: RN9.4 U5.13(B6) U6.12(D2) U207.13(B6) U208.12(D2) U211.10(D3) U237.16(B3) U249.13(B6) U253.12(D2) U282.1(+) U297.10(D3) U337.16(B3) U359.3
DATA3: RN9.5 U5.14(B5) U6.11(D3) U207.14(B5) U208.11(D3) U211.12(D4) U237.15(B4) U249.14(B5) U253.11(D3) U283.1(+) U297.12(D4) U337.15(B4) U359.4
DATA4: RN9.6 U1.4(D1) U5.15(B4) U7.14(D0) U207.15(B4) U209.14(D0) U237.14(B5) U249.15(B4) U284.1(+) U296.4(D1) U337.14(B5) U359.5
DATA5: RN9.7 U1.6(D2) U5.16(B3) U7.13(D1) U207.16(B3) U209.13(D1) U237.13(B6) U249.16(B3) U285.1(+) U296.6(D2) U337.13(B6) U359.6
DATA6: RN9.8 U1.10(D3) U5.17(B2) U7.12(D2) U207.17(B2) U209.12(D2) U237.12(B7) U249.17(B2) U286.1(+) U296.10(D3) U337.12(B7) U359.7
DATA7: RN9.9 U1.12(D4) U5.18(B1) U7.11(D3) U207.18(B1) U209.11(D3) U237.11(B8) U249.18(B1) U287.1(+) U296.12(D4) U337.11(B8) U359.8
DMA: U202.16(Y14)
EO: U202.10(Y9) U203.1(1A) U237.19(OE#)
HLT: U202.13(Y11) U295.4(2A) U295.5(2B)
IN: U369.3
INT: R62.1 SW6.2 U358.2(1D)
INT0: U356.3(B0) U357.4 U363.1
INT1: U356.6(B1) U357.3 U363.2
INT2: U356.10(B2) U357.2 U363.3
INT3: U356.13(B3) U357.1 U363.4
JMP: U202.14(Y12) U353.1(A)
LDP: U202.15(Y13)
MI: U202.9(Y8) U253.9(DE1) U253.10(DE2)
N-FLAG: U68.10(S3) U237.9(A8) U245.1(+) U315.8(3A) U319.12(D2)
OUT: U369.4
PRI: R44.1 SW1.4 U1.3(R/W#) U211.3(R/W#)
RI: R6.2 SW2.4 U204.3(1Y) U296.3(R/W#) U297.3(R/W#)
RO: U203.11(4Y) U249.19(OE#)
RST: R55.2 SW5.2 U6.15(RST) U7.15(RST) U208.15(RST) U209.15(RST) U212.1(1A) U253.15(RST) U319.15(RST) U369.2
SEL: U212.13(6A) U250.1(SEL) U252.2 U252.5 U254.1(SEL) U300.19(OE#)
Z-FLAG: U316.3(1Y) U319.14(D0)
$1N62726: U203.3(1Y) U203.4(2A)
$1N62727: U203.6(2Y) U203.9(3A)
$1N62730: U202.1(Y0) U203.10(3B) U203.13(4B) U205.12(4A)
$1N62731: U202.2(Y1) U203.5(2B)
$1N62732: U202.3(Y2) U203.2(1B)
$1N62735: U204.6(2Y) U204.9(3A)
$1N62736: U202.4(Y3) U203.12(4A) U204.10(3B)
$1N62737: U202.6(Y5) U204.4(2A)
$1N62746: U202.5(Y4) U204.5(2B) U205.2(1B)
$1N62749: U202.8(Y7) U204.1(1A) U205.13(4B)
$1N62750: U5.2(A1) U7.6(Q3) U68.12(A3) U235.1(+)
$1N62751: U5.3(A2) U7.5(Q2) U68.14(A2) U234.1(+)
$1N62752: U5.4(A3) U7.4(Q1) U68.3(A1) U233.1(+)
$1N62753: U5.5(A4) U7.3(Q0) U68.5(A0) U232.1(+)
$1N62754: U5.6(A5) U6.6(Q3) U69.12(A3) U231.1(+)
$1N62755: U5.7(A6) U6.5(Q2) U69.14(A2) U230.1(+)
$1N62756: U5.8(A7) U6.4(Q1) U69.3(A1) U229.1(+)
$1N62757: U5.9(A8) U6.3(Q0) U69.5(A0) U236.1(+)
$1N62780: U71.9(3A) U207.3(A2) U209.5(Q2) U226.1(+)
$1N62781: U71.4(2A) U207.4(A3) U209.4(Q1) U225.1(+)
$1N62782: U71.1(1A) U207.5(A4) U209.3(Q0) U224.1(+)
$1N62783: U70.12(4A) U207.6(A5) U208.6(Q3) U223.1(+)
$1N62784: U70.9(3A) U207.7(A6) U208.5(Q2) U222.1(+)
$1N62785: U70.4(2A) U207.8(A7) U208.4(Q1) U221.1(+)
$1N62786: U70.1(1A) U207.9(A8) U208.3(Q0) U228.1(+)
$1N62809: U1.5(Q1#) U210.5(3A)
$1N62810: U1.7(Q2#) U210.3(2A)
$1N62811: U1.9(Q3#) U210.9(4A)
$1N62812: U1.11(Q4#) U210.11(5A)
$1N62821: U211.5(Q1#) U212.5(3A)
$1N62822: U211.9(Q3#) U212.9(4A)
$1N62823: U211.11(Q4#) U212.11(5A)
$1N62833: U211.7(Q2#) U212.3(2A)
$1N62834: RN5.9 U227.2(-)
$1N62835: RN5.8 U226.2(-)
$1N62836: RN5.7 U225.2(-)
$1N62837: RN5.6 U224.2(-)
$1N62838: RN5.5 U223.2(-)
$1N62839: RN5.4 U222.2(-)
$1N62840: RN5.3 U221.2(-)
$1N62841: RN5.2 U228.2(-)
$1N62842: RN6.9 U235.2(-)
$1N62843: RN6.8 U234.2(-)
$1N62844: RN6.7 U233.2(-)
$1N62845: RN6.6 U232.2(-)
$1N62846: RN6.5 U231.2(-)
$1N62847: RN6.4 U230.2(-)
$1N62848: RN6.3 U229.2(-)
$1N62849: RN6.2 U236.2(-)
$1N62852: U71.12(4A) U207.2(A1) U209.6(Q3) U227.1(+)
$1N62853: U68.7(CIN) U69.9(COUT)
$1N62854: U69.4(S0) U237.2(A1) U244.1(+) U315.2(1A)
$1N62855: U69.1(S1) U237.3(A2) U243.1(+) U315.3(1B)
$1N62856: U69.13(S2) U237.4(A3) U242.1(+) U315.5(2A)
$1N62857: U69.10(S3) U237.5(A4) U241.1(+) U315.6(2B)
$1N62880: RN7.9 U244.2(-)
$1N62881: RN7.8 U243.2(-)
$1N62882: RN7.7 U242.2(-)
$1N62883: RN7.6 U241.2(-)
$1N62884: RN7.5 U240.2(-)
$1N62885: RN7.4 U239.2(-)
$1N62886: RN7.3 U238.2(-)
$1N62887: RN7.2 U245.2(-)
$1N62888: U206.5(3A) U296.5(Q1#)
$1N62889: U206.3(2A) U296.7(Q2#)
$1N62890: U206.9(4A) U296.9(Q3#)
$1N62891: U206.11(5A) U296.11(Q4#)
$1N62932: U248.5(3A) U297.5(Q1#)
$1N62933: U248.3(2A) U297.7(Q2#)
$1N62934: U248.9(4A) U297.9(Q3#)
$1N62935: U248.11(5A) U297.11(Q4#)
$1N62946: U248.6(3Y) U249.9(A8) U314.1(+)
$1N62947: U248.4(2Y) U249.8(A7) U307.1(+)
$1N62948: U248.8(4Y) U249.7(A6) U308.1(+)
$1N62949: U248.10(5Y) U249.6(A5) U309.1(+)
$1N62950: U206.6(3Y) U249.5(A4) U310.1(+)
$1N62951: U206.4(2Y) U249.4(A3) U311.1(+)
$1N62952: U206.8(4Y) U249.3(A2) U312.1(+)
$1N62953: U206.10(5Y) U249.2(A1) U313.1(+)
$1N62981: U250.11(A2) U251.3 U360.2
$1N62982: U250.5(A1) U251.2 U360.3
$1N62983: U250.2(A0) U251.1 U360.4
$1N62984: U34.14(QA) U250.3(B0) U259.1(+)
$1N62985: U34.13(QB) U250.6(B1) U256.1(+)
$1N62986: U34.12(QC) U250.10(B2) U257.1(+)
$1N62987: U34.11(QD) U250.13(B3) U258.1(+)
$1N62990: U34.7(ENP) U34.10(ENT) U212.12(6Y) U280.1(+)
$1N63027: U253.6(Q3) U254.3(B0) U279.1(+)
$1N63028: U253.5(Q2) U254.6(B1) U276.1(+)
$1N63029: U253.4(Q1) U254.10(B2) U277.1(+)
$1N63030: U253.3(Q0) U254.13(B3) U278.1(+)
$1N63051: RN8.9 U287.2(-)
$1N63052: RN8.8 U286.2(-)
$1N63053: RN8.7 U285.2(-)
$1N63054: RN8.6 U284.2(-)
$1N63055: RN8.5 U283.2(-)
$1N63056: RN8.4 U282.2(-)
$1N63057: RN8.3 U281.2(-)
$1N63058: RN8.2 U288.2(-)
$1N63097: U202.7(Y6) U204.2(1B) U205.1(1A)
$1N63098: C2.2 PR1.3 U291.2(TRIG) U291.6(THRES)
$1N63102: R53.1 SW3.4 U2.2(TRIG)
$1N63105: C50.2 R49.2 U2.6(THRES) U2.7(DISCH)
$1N63106: U2.3(OUT) U294.10(3B)
$1N63108: U294.2(1B) U294.6(2Y)
$1N63109: U294.3(1Y) U294.12(4A)
$1N63110: U294.8(3Y) U294.13(4B)
$1N63111: U294.11(4Y) U295.10(3B)
$1N63112: U295.6(2Y) U295.9(3A)
$1N63115: U295.1(1A) U295.2(1B) U295.8(3Y)
$1N63118: R51.2 R52.2 U291.7(DISCH)
$1N63136: R30.2 U298.2(-)
$1N63137: U291.3(OUT) U294.1(1A)
$1N63144: U68.6(B0) U71.3(1Y)
$1N63145: U68.2(B1) U71.6(2Y)
$1N63146: U68.15(B2) U71.8(3Y)
$1N63147: U68.11(B3) U71.11(4Y)
$1N63148: U69.6(B0) U70.3(1Y)
$1N63149: U69.2(B1) U70.6(2Y)
$1N63150: U69.15(B2) U70.8(3Y)
$1N63151: U69.11(B3) U70.11(4Y)
$1N63156: R42.2 U202.23(A0) U300.2(A1) U302.6(Q3) U344.1(+) U349.1(+)
$1N63159: R35.2 U202.20(A3) U300.5(A4) U302.3(Q0) U341.1(+) U346.1(+)
$1N63164: U301.7(CLK) U302.7(CLK)
$1N63166: U301.15(RST) U302.15(RST)
$1N63169: RN4.8 U213.2(-)
$1N63170: RN4.7 U214.2(-)
$1N63171: RN4.9 U220.2(-)
$1N63174: U34.1(CLR#) U212.2(1Y)
$1N63175: RN12.5 U259.2(-)
$1N63176: RN12.4 U256.2(-)
$1N63177: RN12.3 U257.2(-)
$1N63178: RN12.2 U258.2(-)
$1N63179: RN12.9 U271.2(-)
$1N63180: RN12.8 U268.2(-)
$1N63181: RN12.7 U269.2(-)
$1N63182: RN12.6 U270.2(-)
$1N63183: RN4.2 U219.2(-)
$1N63184: RN4.3 U218.2(-)
$1N63185: RN4.4 U217.2(-)
$1N63186: RN4.5 U216.2(-)
$1N63187: RN4.6 U215.2(-)
$1N63239: RN15.9 U278.2(-)
$1N63241: RN15.8 U277.2(-)
$1N63244: RN15.7 U276.2(-)
$1N63248: RN15.6 U279.2(-)
$1N63252: RN15.5 U274.2(-)
$1N63256: RN15.4 U273.2(-)
$1N63261: RN15.3 U272.2(-)
$1N63266: RN15.2 U275.2(-)
$1N63568: RN16.5 U309.2(-)
$1N63569: RN16.3 U307.2(-)
$1N63570: RN16.4 U308.2(-)
$1N63571: RN16.9 U313.2(-)
$1N63572: RN16.8 U312.2(-)
$1N63573: RN16.7 U311.2(-)
$1N63574: RN16.6 U310.2(-)
$1N63575: RN16.2 U314.2(-)
$1N68251: U315.10(3Y) U316.10(3B)
$1N68260: U315.13(4Y) U316.9(3A)
$1N68271: U315.1(1Y) U316.5(2B)
$1N68279: U315.4(2Y) U316.4(2A)
$1N68290: U316.2(1B) U316.6(2Y)
$1N68299: U316.1(1A) U316.8(3Y)
$1N68580: U68.13(S2) U237.8(A7) U238.1(+) U315.9(3B)
$1N68588: U68.1(S1) U237.7(A6) U239.1(+) U315.11(4A)
$1N68596: U68.4(S0) U237.6(A5) U240.1(+) U315.12(4B)
$1N72572: U319.3(Q0) U322.1(+) U350.1(A)
$1N72604: U319.4(Q1) U328.1(+) U351.1(A)
$1N72636: U319.5(Q2) U329.1(+) U352.1(A)
$1N72692: R32.1 U322.2(-)
$1N72718: R33.1 U328.2(-)
$1N72744: R34.1 U329.2(-)
$1N89328: R46.2 U280.2(-)
$1N89401: PR1.2 R51.1
$1N93880: R54.2 U330.2(-)
$1N94984: R56.1 U331.2(-)
$1N95139: R57.1 U332.1(+)
$1N95360: C49.2 U291.5(CONT)
$1N95397: C48.2 U2.5(CONT)
$1N102456: U334.2 U334.5 U337.19(OE#)
$1N108953: U250.14(A3) U251.4 U360.1
$1N108990: U254.14(A3) U255.4 U361.1
$1N109004: U254.11(A2) U255.3 U361.2
$1N109041: U254.5(A1) U255.2 U361.3
$1N109068: U254.2(A0) U255.1 U361.4
$1N109679: RN17.5 U340.2(-)
$1N109680: RN17.4 U339.2(-)
$1N109681: RN17.3 U338.2(-)
$1N109682: RN17.2 U345.2(-)
$1N109683: RN17.7 U342.2(-)
$1N109684: RN17.6 U341.2(-)
$1N109685: RN17.9 U344.2(-)
$1N109686: RN17.8 U343.2(-)
$1N110843: R58.1 U346.2(-)
$1N110845: R59.1 U347.2(-)
$1N110847: R60.1 U348.2(-)
$1N110849: R61.1 U349.2(-)
$1N110887: R40.2 U202.22(A1) U300.3(A2) U302.5(Q2) U343.1(+) U348.1(+)
$1N110899: R37.2 U202.21(A2) U300.4(A3) U302.4(Q1) U342.1(+) U347.1(+)
$1N115915: U289.8 U337.2(A1) U368.8
$1N115921: U289.7 U337.3(A2) U368.7
$1N115927: U289.6 U337.4(A3) U368.6
$1N115933: U289.5 U337.5(A4) U368.5
$1N115939: U290.8 U337.6(A5) U368.4
$1N115945: U290.7 U337.7(A6) U368.3
$1N115951: U290.6 U337.8(A7) U368.2
$1N115958: U290.5 U337.9(A8) U368.1
$1N141518: U34.9(LOAD#) U210.12(6Y)
$1N141524: U210.13(6A) U350.2(K) U351.2(K) U352.2(K) U353.2(K)
$1N142056: U300.9(A8) U301.3(Q0) U345.1(+) U356.14(A3)
$1N142068: U300.8(A7) U301.4(Q1) U338.1(+) U356.11(A2)
$1N142080: U300.7(A6) U301.5(Q2) U339.1(+) U356.5(A1)
$1N142092: U300.6(A5) U301.6(Q3) U340.1(+) U356.2(A0)
$1N142099: U34.3(A) U356.4(Y0)
$1N142109: U34.4(B) U356.7(Y1)
$1N142119: U34.5(C) U356.9(Y2)
$1N142163: U34.6(D) U356.12(Y3)
$1N142574: U356.1(SEL) U358.5(1Q)
$1N182187: U300.11(B8) U301.14(D0) U364.4(Y0)
$1N182193: U212.6(3Y) U220.1(+) U364.2(A0)
$1N182199: U300.12(B7) U301.13(D1) U364.7(Y1)
$1N182205: U212.4(2Y) U213.1(+) U364.5(A1)
$1N182212: U212.8(4Y) U214.1(+) U364.11(A2)
$1N182218: U300.13(B6) U301.12(D2) U364.9(Y2)
$1N182226: U212.10(5Y) U215.1(+) U364.14(A3)
$1N182232: U300.14(B5) U301.11(D3) U364.12(Y3)
$1N182238: U210.6(3Y) U216.1(+) U365.2(A0)
$1N182244: U300.15(B4) U302.14(D0) U365.4(Y0)
$1N182250: U300.16(B3) U302.13(D1) U365.7(Y1)
$1N182256: U210.4(2Y) U217.1(+) U365.14(A3)
$1N182264: U210.8(4Y) U218.1(+) U365.5(A1)
$1N182270: U300.17(B2) U302.12(D2) U365.9(Y2)
$1N182276: U300.18(B1) U302.11(D3) U365.12(Y3)
$1N182284: U210.10(5Y) U219.1(+) U365.11(A2)
$1N182612: U364.3(B0) U366.1
$1N182616: U364.6(B1) U366.2
$1N182626: U364.10(B2) U366.3
$1N182634: U364.13(B3) U366.4
$1N182644: U365.3(B0) U366.5
$1N182654: U365.6(B1) U366.6
$1N182662: U365.10(B2) U366.7
$1N182669: U365.13(B3) U366.8
$1N182680: U364.1(SEL) U365.1(SEL) U367.2 U367.5

Not connected (* = marked no-connect by the designer): PR1 1*; SW1 1* 3*; SW2 1* 3*; SW3 1* 3*; SW5 1* 3*; SW6 1* 3*; U34 15(RCO)*; U202 17(Y15)*; U204 11(4Y)*; U205 6(2Y)* 8(3Y)*; U206 1(1A) 2(1Y)* 12(6Y)*; U210 2(1Y)*; U248 2(1Y)* 12(6Y)*; U295 11(4Y)*; U316 11(4Y) 12(4A) 13(4B); U319 6(Q3) 11(D3); U358 6(1Q#) 8(2Q#) 9(2Q) 10(2PRE#)
